# EasyEDA Pro project ProProject_Avaota Pi A_2024-03-25.epro, board 点位 (continued)
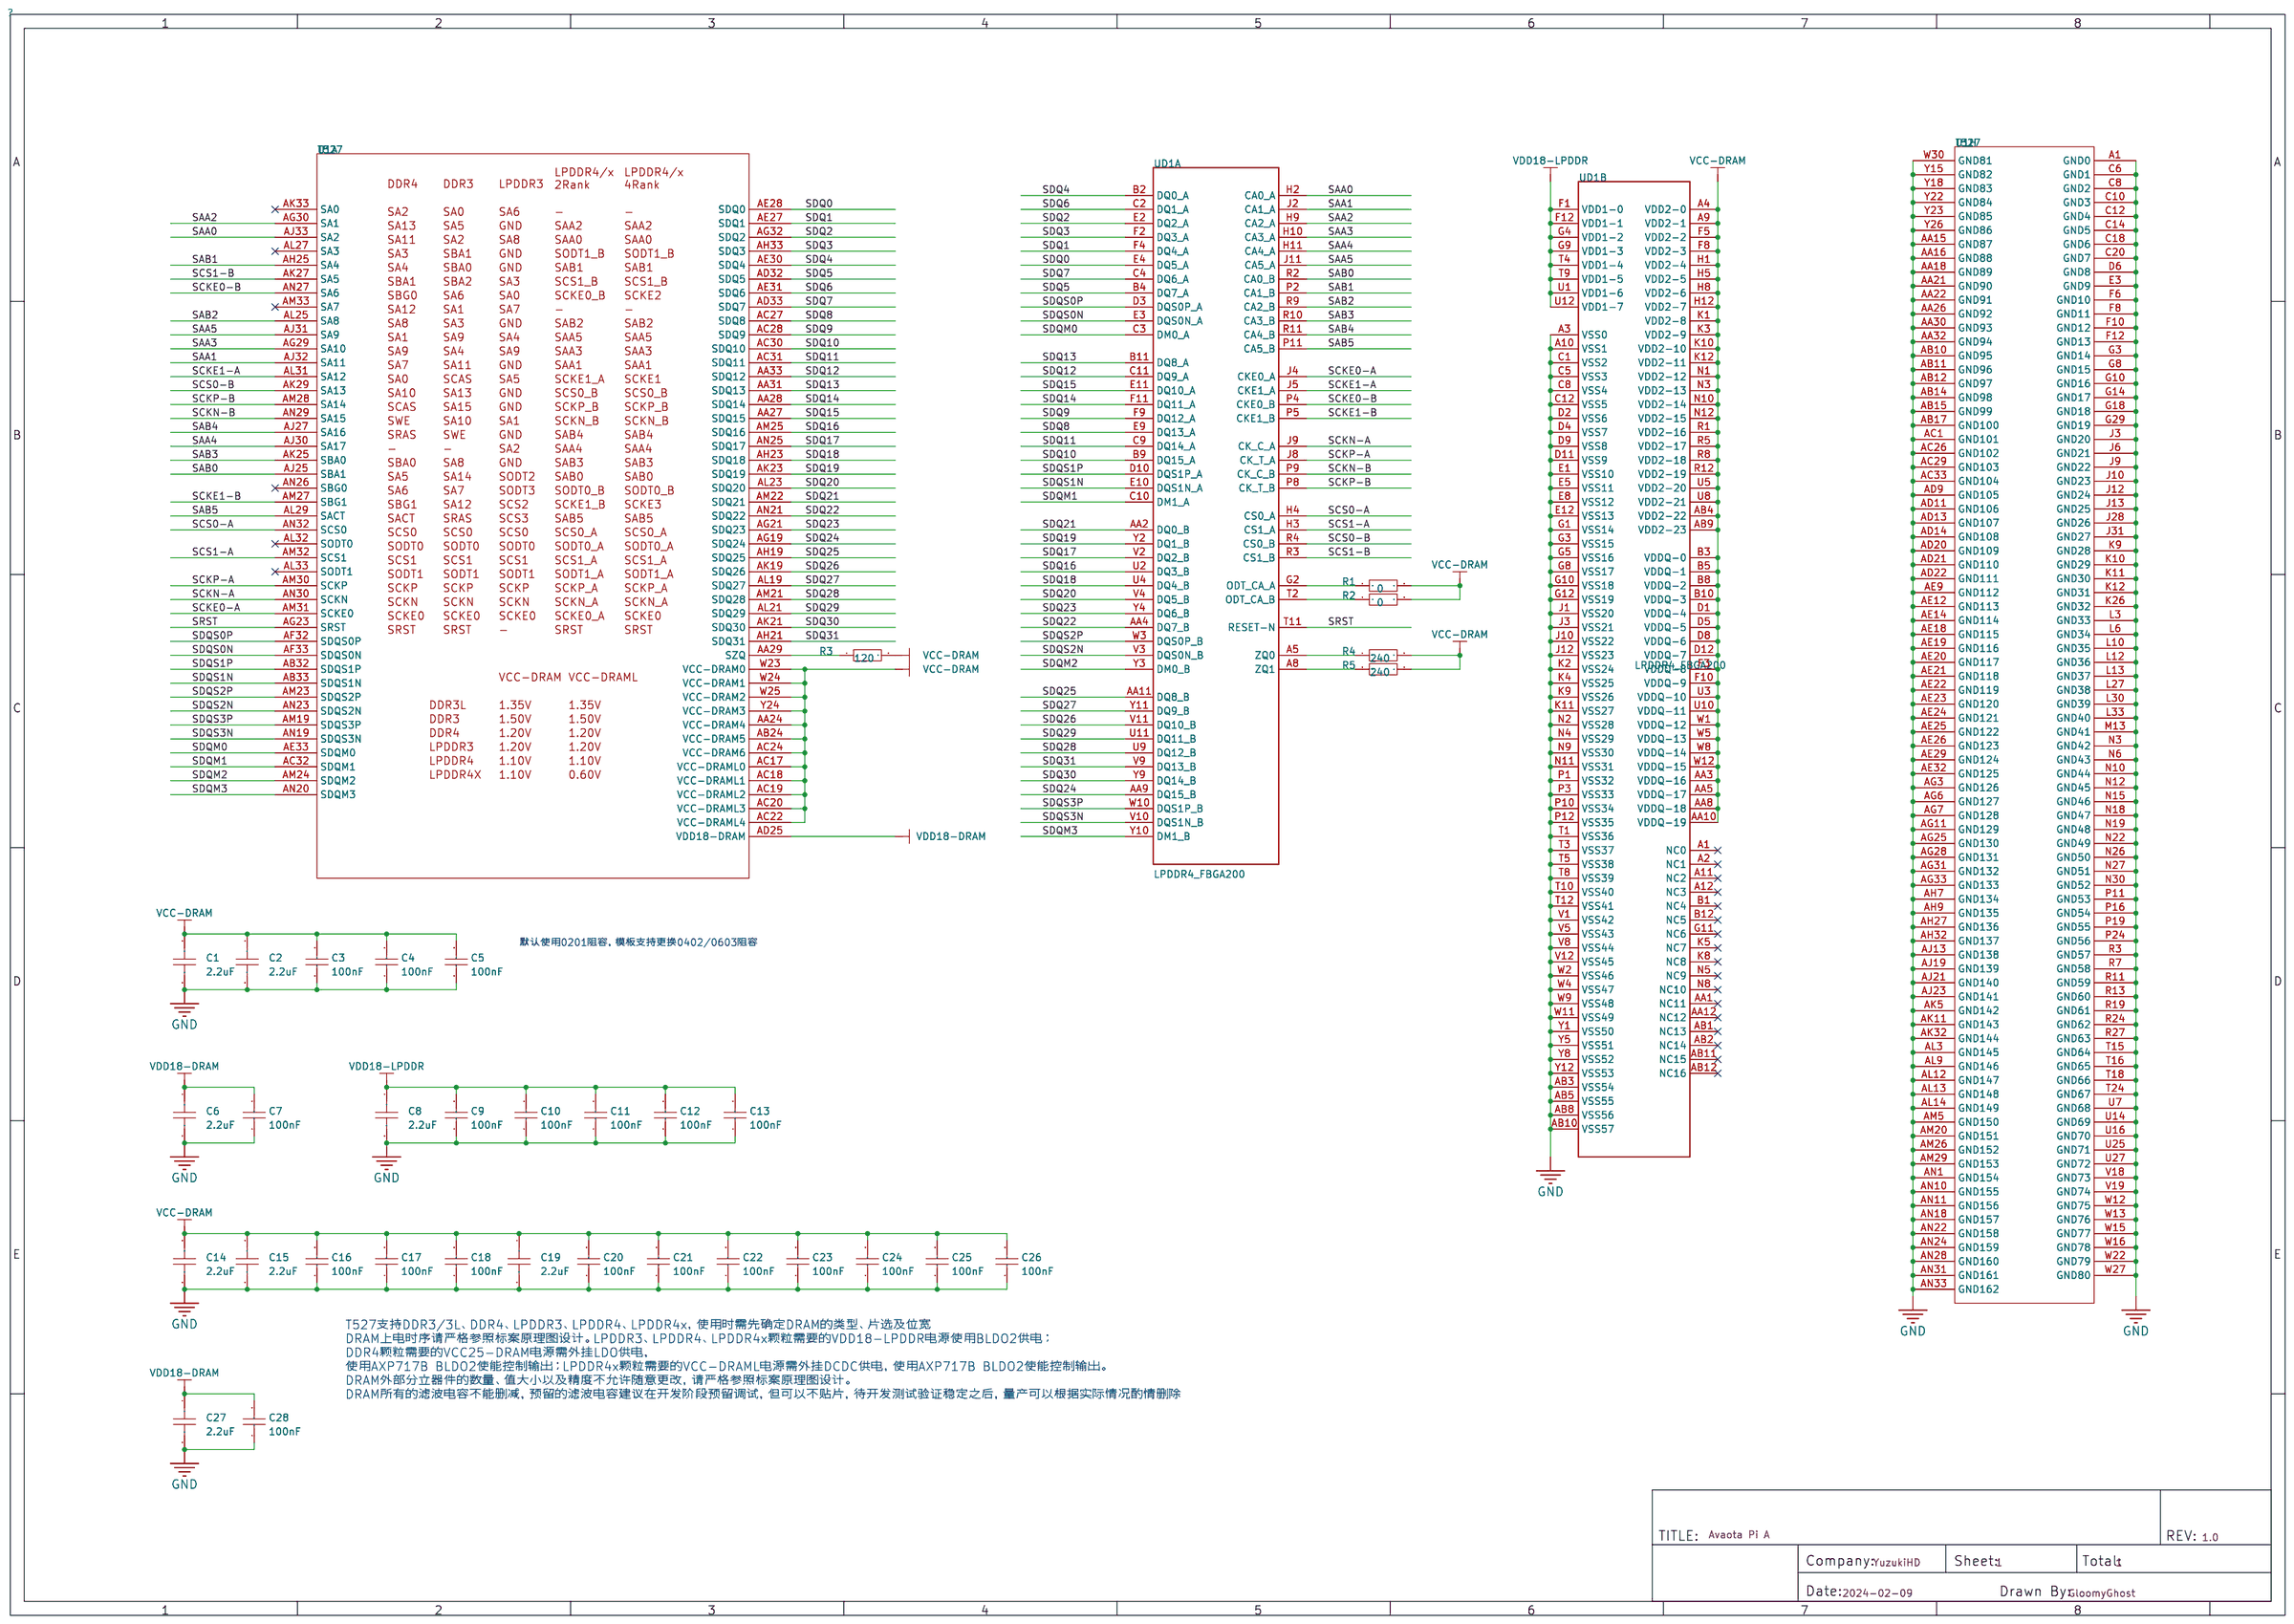
[diagram p0: schematic sheet]
## Routing (per net, layer and track width the routed paths; a pad name or vN(x,y) marks a point on that pad's centre or on a via; arc(x,y) is an arc through that point) (continued)
VDD-CPUBFB: length 71
  Top Layer w0.203: v3(17.37,44.68) 17.31,44.68 U5.1 ; v3(17.65,41.86) 17.66,41.87 U5.16
  内层2 w0.254: v1(62.44,45.65) 63.32,45.65 64.01,46.33 64.01,46.86 63.37,47.5 63.37,49.07 62.31,50.14 61.72,50.14 61.49,50.37 61.49,50.88 61.95,51.33 61.95,52.02 61.9,52.02 61.29,52.63 61.29,53.49 60.88,53.9 59.82,53.9 57.18,56.54 56.57,56.54 55.63,57.48 55.63,57.84 52.58,60.88 31.9,60.88 27.1,56.08 27.1,53.19 18.59,44.68 v3(17.37,44.68)
  Bottom Layer w0.254: v3(17.37,44.68) 17.81,44.68 18.26,44.22 18.26,43.49 17.65,42.88 v3(17.65,41.86)
VDD-CPULFB: length 62
  Top Layer w0.152: U4.12 10.87,48.88 v3(10.87,48.31)
  Inner5 w0.254: v3(10.87,48.31) 10.39,47.83 10.39,45.85 11.38,44.86 13.61,44.86 17.93,49.17 25.6,49.17 32.56,56.13 46.25,56.13 51.23,51.16 51.82,51.16 52.1,50.88 52.1,50.29 52.68,49.71 53.62,49.71 54.15,49.17 57.61,49.17 57.94,48.84 58.42,48.84 58.85,48.41 58.85,47.42 59.13,47.14 v1(59.44,47.14)
VDD-DNRFB: length 52.6
  Top Layer w0.203: v1(15.34,45.92) 15.47,45.92 15.65,45.75 15.65,45.01 15.85,44.8 U5.4
  VCC w0.254: v1(15.34,45.92) 15.8,46.38 22.4,46.38 31.88,55.85 45.85,55.85 52.48,49.23 58.02,49.23 v1(58.94,50.15)
VDD-SYSFB: length 65.7
  Top Layer w0.203: v3(8.05,54.15) 8.06,54.17 U4.34
  Top Layer w0.254: v1(62.94,48.16) 62.94,47.65
  内层4 w0.254: v1(62.94,48.16) 62.94,48.01 62.56,47.62 60.27,47.62 58.75,49.15 52.55,49.15 45.47,56.24 20.07,56.24 16.87,59.44 14.55,59.44 13.94,60.05 10.85,60.05 9.09,58.29 9.09,57.05 8.05,56.01 v3(8.05,54.15)
323-ALDO1: length 0.8
  Top Layer w0.203: U5.15 17.05,40.9 C69.1
323-DCDC1/2: length 10.9
  Top Layer w0.203: 61.95,46.66 61.95,46.15 U14.T21 ; 61.95,46.66 61.95,47.14 U14.T19 ; 61.95,46.66 v1(61.44,46.66) ; 61.44,46.66 U14.U19 U14.U18 ; v1(61.44,46.66) v1(60.93,46.66) 60.96,46.63 v1(60.96,46.15) ; v1(61.44,46.66) U14.U21
  Bottom Layer w0.254: v1(61.94,45.65) 61.95,45.64 C22.1 62.5,45.12 62.51,45.14 ; v1(61.94,45.65) v1(61.44,45.65) ; v1(61.94,45.65) 61.94,46.94 C24.1 C19.1 61.44,46.88 v1(61.44,46.66) ; v1(61.44,46.66) v1(60.93,46.66) 60.96,46.63 v1(60.96,46.15) 60.96,45.71 60.9,45.64 ; v1(61.44,46.66) v1(61.44,45.65) ; v1(61.44,45.65) C23.1
  vias: v3(21.97,45.01) v3(21.97,44.36) v3(21.97,43.69) v3(21.97,43.05) v3(21.97,42.48) v3(21.97,41.76) v3(22.05,41.05) v3(22.57,41.05)
323-DCDC3: length 5.1
  Top Layer w0.254: v1(59.94,49.64) v1(59.94,50.15) U14.Y12 ; U14.AA12 v1(59.44,50.15) v1(59.44,49.64)
  Bottom Layer w0.254: v1(59.44,50.15) v1(59.44,49.64) 59.44,49.51 C83.1 ; C84.1 C83.1 ; C83.1 59.77,49.46 v1(59.94,49.64) 60.12,49.46 C86.1 ; C85.1 59.94,49.53 v1(59.94,50.15)
  vias: v3(18.21,48.49) v3(18.21,47.89) v3(18.73,47.89) v3(18.72,47.34)
323-DLDO1: length 0.8
  Top Layer w0.203: C71.1 15.85,40.91 U5.12
323-RTCLDO: length 1.1
  Top Layer w0.203: U5.7 14.84,43.41 14.3,43.41 14.1,43.61 C73.1
ADCIN0: length 4.1
  Bottom Layer w0.152: C106.2 60.67,55.42 R26.2 60.83,55.33 60.83,52.54
  Bottom Layer w0.178: v3(60.44,52.15) 60.83,52.54
ADCIN1: length 4.7
  Bottom Layer w0.178: v3(60.44,51.65) 60.51,51.65 61.14,52.27 61.14,55.07 61.28,55.21 R27.2 61.28,55.94 C107.2
ALDO1: length 2.2
  Top Layer w0.203: U4.13 11.63,49.2 11.63,48.92 12.01,48.54 12.27,48.54 12.47,48.34 12.47,48.11 12.75,47.83 C51.1
ALDO2: length 2
  Top Layer w0.203: C52.1 12.84,48.41 12.09,49.17 12.09,49.43 11.89,49.63 U4.14
ALDO3: length 80.2
  Top Layer w0.152: R12.1 R11.1 v3(5.18,47.12)
  Top Layer w0.203: U4.16 11.94,50.43 12.69,49.68 12.69,49.53 v1(12.92,49.53)
  Top Layer w0.254: v1(56.44,52.15) U14.AE11
  Top Layer w0.457: v1(49.53,61.54) 49.53,61.57 v1(49.15,61.95) 49.05,62.05 v1(42.11,62.05) v1(41.5,62.05)
  VCC w0.152: v3(5.18,47.12) 5.53,47.47 5.99,47.47 6.58,48.06 6.58,49.15 6.43,49.3 6.43,49.71 6.81,50.09 6.81,54 7.39,54.58 11.13,54.58 11.96,53.75 11.96,52.86 12.47,52.35 12.47,49.97 v1(12.92,49.53)
  Inner5 w0.457: v1(12.92,49.53) 12.57,49.53 12.14,49.96 12.14,51.21 12.73,51.79 13.37,51.79 14.79,53.21 18.62,53.21 20.6,55.19 22.92,55.19 29.78,62.05 v1(41.5,62.05)
  Bottom Layer w0.254: v1(49.53,61.54) 49.5,61.52 49.5,60.17 50.6,59.08 50.6,57.66 52.15,56.11 52.15,55.47 53.62,54 53.92,54 54.15,54.23 54.79,54.23 54.91,54.1 55.19,54.1 55.45,53.85 55.45,53.49 56.44,52.5 v1(56.44,52.15)
ALDO4: length 103.7
  Top Layer w0.102: v3(59.79,59.82) R31.2 60.35,59.37 ; R20.2 60.91,59.37 60.35,59.37 ; 60.35,59.37 R19.2 ; v3(58.67,59.84) R30.2 ; v3(56.97,59.79) R32.2
  Top Layer w0.203: U14.AD15 U14.AG15 ; v1(12.92,50.09) 12.85,50.09 12.11,50.83 U4.17 ; v3(60.44,53.15) 59.95,52.65 59.26,52.65 58.94,52.34 U14.AB9
  Top Layer w0.254: U14.AG15 56.44,49.14 v1(56.44,48.62)
  内层2 w0.254: v3(56.97,59.79) 56.97,59.56 57.25,59.28 58.22,59.28 58.67,59.74 v3(58.67,59.84)
  VCC w0.381: 58.93,49.35 57.74,48.16 57.2,48.16 56.74,48.62 v1(56.44,48.62) ; 58.93,49.35 59.21,49.07 60.35,49.07 60.93,49.66 v1(60.93,51.43) 60.93,52.65 v3(60.44,53.15) 59.68,53.15 58.85,53.98 58.85,57 58.39,57.46 58.39,58.47 58.67,58.75 v3(58.67,59.84) 58.67,60.05 58.98,60.35 59.46,60.35 59.79,60.02 v3(59.79,59.82) ; 58.93,49.35 58.93,45.36 58.72,45.16 58.19,45.16 57.94,44.91 v3(57.94,44.15)
  Inner5 w0.457: 12.92,50.09 12.92,50.09 13.39,50.09 13.87,50.57 13.87,51.26 15.09,52.48 18.77,52.48 ; 18.85,52.53 20.8,54.48 23.3,54.48 30.11,61.29 45.82,61.29 48.77,58.34 54.53,58.34 56.87,56.01 58.7,56.01 60.44,54.26 v3(60.44,53.15)
  Bottom Layer w0.127: R24.2 60.19,51.26 60.76,51.26 v1(60.93,51.43)
  Bottom Layer w0.152: v3(60.44,53.15) 60.44,53.2 59.72,53.92
  Bottom Layer w0.203: v3(60.44,53.15) 60.25,53.34 59.72,53.34
  Bottom Layer w0.254: C90.2 C93.2 56.24,48.91 56.44,48.71 v1(56.44,48.62) ; C133.2 57.94,43.67 57.94,44.02 ; 57.94,44.02 57.63,43.71 57.21,43.71 56.7,44.22 52.72,44.22 52.58,44.37 ; 57.94,44.02 v3(57.94,44.15) ; 52.58,44.37 51.62,44.37 51.61,44.36 ; 52.58,44.37 52.55,44.34
ALDO-OUT: length 0.4
  Bottom Layer w0.178: v3(57.44,53.15) 57.43,53.14 57.43,53.14 C103.2
AP-NMI: length 84.7
  Top Layer w0.076: 53.04,51.4 53.7,51.4
  Top Layer w0.102: v1(7.57,54.08) 7.09,54.08 6.83,54.33 6.83,54.73 U4.37 ; U14.AM10 53.94,51.65 53.7,51.4 ; v3(52.81,51.63) 53.04,51.4
  Top Layer w0.127: v3(13.41,41.76) 15.3,41.76 U5.11
  Top Layer w0.152: R10.2 7.79,48.01 v1(7.39,48.01)
  VCC w0.102: v1(7.44,49.58) 7.07,49.96 7.07,53.57 v1(7.57,54.08)
  VCC w0.152: v1(7.44,49.58) 7.39,49.53 v1(7.39,48.01)
  Bottom Layer w0.102: v3(52.81,51.63) 52.79,51.61 51.99,51.61 47.65,55.96 43.84,55.96 42.27,57.53 36.37,57.53 35.69,56.85 13.59,56.85 11.91,55.17 11.91,50.62 11.71,50.42 9.6,50.42 9.09,49.91 7.77,49.91 v1(7.44,49.58) 7.09,49.23 6.53,49.23 5.77,49.99 4.98,49.99 4.52,49.53 4.52,48.77 5.26,48.03 5.26,47.85 4.8,47.4 4.8,46.91 5.28,46.43 5.28,45.8 6.66,44.42 12.27,44.42 13.28,43.41 13.28,41.88 v3(13.41,41.76)
  Bottom Layer w0.254: C94.2 53.28,51.63 v3(52.81,51.63)
AP-RESET: length 84.1
  Top Layer w0.127: U5.13 16.25,41.03 v3(16.26,41.02)
  Top Layer w0.152: C95.2 6.77,47.97 R9.2 6.31,48.01 6.31,48.45 6.46,48.6 U4.1 6.46,49.49 6.58,49.61 v1(6.86,49.61)
  Top Layer w0.254: v3(55.45,51.64) 55.45,51.15 U14.AJ11
  VCC w0.127: v1(14.6,44.3) 14.5,44.2 8.84,44.2 ; v1(8.84,43.13) 8.84,44.2 ; 8.84,44.2 6.83,46.2 6.83,49.58 v1(6.86,49.61)
  Bottom Layer w0.102: v1(6.86,49.61) 7.44,50.19 9.04,50.19 9.47,50.62 11.48,50.62 11.68,50.83 11.68,55.4 13.41,57.12 35.51,57.12 36.25,57.86 42.37,57.86 43.99,56.24 47.78,56.24 52.15,51.87 52.55,51.87 52.65,51.97 52.7,51.97 52.88,52.15 54.66,52.15 55.14,51.66 55.4,51.66
  Bottom Layer w0.127: R21.2 8.82,43.15 v1(8.84,43.13) ; v1(14.6,44.3) 14.6,42.67 v3(16.26,41.02)
AP-WAKE-BT: length 52.7
  Top Layer w0.102: v3(61.95,54.65) U14.U4
  Top Layer w0.203: 15.72,60.6 15.61,60.5 R69.2
  Top Layer w0.254: v3(17.02,60.53) U9.6
  Inner5 w0.102: v3(17.02,60.53) 17.6,59.94 19.3,59.94 22.07,62.71 45.14,62.71 48.97,58.88 55.07,58.88 56.34,57.61 57.84,57.61 60.8,54.65 v3(61.95,54.65)
AXP717-CC1: length 3.9
  Top Layer w0.102: D24.2 86.66,66.43 86.66,65.35 86.98,65.04 R130.2
  Top Layer w0.127: 87.07,66.86 87.07,67.44 86.92,67.59 86.92,68.53 USB3.A5
AXP717-CC2: length 2.8
  Top Layer w0.102: R129.2 83.11,66.92 D31.2
  Top Layer w0.127: USB3.B5 83.9,67.6 D31.2 83.13,66.84
BLDO1: length 102
  Top Layer w0.152: v1(16.1,53.95) 16.07,53.91 16.07,52.07 ; U14.N9 v3(63.44,52.58) ; U14.T9 62.08,52.15 62.46,52.53 v3(62.46,52.68)
  Top Layer w0.203: U4.18 12.2,51.23 12.78,50.65 v1(12.92,50.65)
  Top Layer w0.254: C179.2 C180.2 14.12,61.71 v1(14.12,61.19) 14.12,60.53 ; 14.12,60.53 R69.1 ; 14.12,60.53 14.12,59.91 R70.1
  Top Layer w0.508: v1(24.71,57.99) 26.04,56.66 U9.22
  VCC w0.254: v1(16.1,53.95) 16.1,54.58 16,54.69
  VCC w0.381: v1(56.92,53.62) 56.44,53.14 54.2,53.14 53.75,53.59
  VCC w0.508: 53.75,53.7 47.29,60.15 30.4,60.15 v1(28.68,58.42) 24.94,54.69 14.49,54.69 13.99,54.18 13.99,51.25 13.39,50.65 v1(12.92,50.65)
  Inner5 w0.254: v1(63.42,44.65) 63.55,44.53 64.08,44.53 64.44,44.88 64.44,47.04 64.9,47.5 64.9,49.81 64.57,50.14 64.21,50.14 62.99,51.36 62.66,51.36 61.87,52.15 ; 62.07,52.15 61.87,52.15 ; 62.07,52.15 63.12,52.15 63.44,52.47 v3(63.44,52.58) ; 62.07,52.15 62.46,52.54 v3(62.46,52.68) ; 61.87,52.15 61.42,52.15 60.91,52.65 58.22,52.65 57.91,52.96 57.91,53.31 57.51,53.72 57.02,53.72 v1(56.92,53.62)
  Bottom Layer w0.254: C165.2 63.45,52.58 v3(63.44,52.58) ; C172.2 56.44,53.95 56.77,53.62 v1(56.92,53.62) ; v1(63.42,44.65) 63.32,44.55 C166.2 C171.2
  Bottom Layer w0.508: v1(28.68,58.42) 25.15,58.42 v1(24.71,57.99) 17.81,57.99 14.6,61.19 v1(14.12,61.19)
BLDO2: length 52.1
  Top Layer w0.102: 35.81,50.05 v2(35.46,49.7)
  Top Layer w0.127: v3(16.64,40.64) 16.65,40.66 U5.14
  Top Layer w0.203: U4.19 12.38,51.63 12.8,51.21 v1(12.92,51.21)
  Top Layer w0.254: 35.81,44.2 36.04,43.97 36.22,43.97 36.23,43.96 v2(36.23,43.96) ; 33.41,50.7 v2(33.1,50.39) 33.07,50.39 32.37,51.09 32.23,51.09 32.23,51.71 ; v2(39.38,43.77) 39.4,43.77 39.81,44.18 39.81,44.2 ; 42.21,43.55 42.15,43.55 v2(41.81,43.21) ; 32.23,43.71 32.7,43.71 v2(32.87,43.55) 33.41,43.55 ; v2(39.39,50.32) 39.54,50.32 39.81,50.05
  Top Layer w0.305: v2(41.83,50.36) 41.84,50.37 41.87,50.37 42.21,50.7
  内层4 w0.508: v2(33.1,50.39) 32.48,50.39 31.57,49.48 17.83,49.48 15.75,51.56 v1(15.06,51.56) 13.27,51.56 v1(12.92,51.21)
  Bottom Layer w0.152: v3(16.64,40.64) 16.64,41.22 15.06,42.8 15.06,44.78 14.48,45.36 14.48,50.98 v1(15.06,51.56)
  Bottom Layer w0.203: v2(39.38,43.77) 39.8,44.19 39.8,44.93 41.12,44.93 41.81,44.25 41.81,43.87
  Bottom Layer w0.254: v2(35.46,49.7) 35.45,49.7 35.02,49.28 34.39,49.28 34.16,49.51 34.16,49.96 33.78,50.34 33.14,50.34 v2(33.1,50.39) ; 38.78,43.26 39.3,43.77 v2(39.38,43.77) ; 35.99,44.4 35.99,44.2 v2(36.23,43.96) ; v2(32.87,43.55) 32.83,43.55 ; 41.81,43.87 v2(41.81,43.21)
BLDO3: length 84.1
  Top Layer w0.152: U14.AJ5 55.64,53.95 v3(55.93,53.95)
  Top Layer w0.203: U4.21 11.6,52.43 12.81,52.43 v1(12.92,52.32)
  Top Layer w0.254: U14.L22 63.96,45.16 v1(63.96,45.09) ; U14.J15 65.46,49.16 64.96,49.66 64.45,49.66 ; 64.45,49.66 U14.K13 ; 64.45,49.66 v1(64.44,49.66) ; v1(63.53,46.63) 63.94,46.22 U14.M21 ; v1(63.96,51.13) 63.96,51.63 U14.M10
  内层2 w0.254: v1(70.36,52.73) 70,52.73 68.94,51.66 65.63,51.66 65.1,51.13 v1(63.96,51.13)
  VCC w0.381: v1(12.92,52.32) 13.41,52.82 13.41,54.46 14.25,55.3 24.56,55.3 30.1,60.83 47.4,60.83 54.1,54.13 55.75,54.13 v3(55.93,53.95)
  Bottom Layer w0.127: C187.2 64.36,47.55
  Bottom Layer w0.254: C202.2 55.62,54.26 v3(55.93,53.95) ; R127.1 R128.1 70.28,52.81 v1(70.36,52.73) ; v1(63.96,45.09) 64.01,45.03 C201.2
  Bottom Layer w0.381: 63.96,50.14 C208.2 61.11,50.14 60.6,50.65 59,50.65 57.99,51.66 57.18,51.66 56.95,51.89 56.95,52.68 55.93,53.7 v3(55.93,53.95)
  Bottom Layer w0.457: 64.36,47.55 65,48.18 65,49.38 64.72,49.66 v1(64.44,49.66) 63.96,50.14 v1(63.96,51.13) ; 64.52,47.52 63.63,46.63 v1(63.53,46.63) 63.83,46.33 C186.2 C185.2 63.83,45.21 v1(63.96,45.09)
BLDO4: length 1.3
  Top Layer w0.203: C65.1 12.89,52.83 U4.22
BOOT-SEL-ADC: length 4.3
  Top Layer w0.076: 59.83,57.33 60.07,56.44 60.42,56.18
  Top Layer w0.102: 59.83,57.33 59.83,58.3 59.59,58.55 58.98,58.55 58.67,58.85 ; R33.2 58.64,58.89 58.67,58.85 ; 58.67,58.85 R30.1
BT-RESETN: length 45.6
  Top Layer w0.076: 61.44,55.14 61.19,55.39 61.19,56.38 61.18,56.38 60.96,56.79 60.91,57.23 60.93,57.78
  Top Layer w0.102: 60.93,57.76 60.93,58.11 61.49,58.67 61.49,59.72 60.99,60.22 56.64,60.22 54.86,58.45 36.14,58.45 v3(35.94,58.24) ; 26.06,66.45 v1(26.06,65.19)
  Bottom Layer w0.102: v3(35.94,58.24) 35.53,58.65 35.41,58.65 28.86,65.19 v1(26.06,65.19)
BT-WAKE-AP: length 54.8
  Top Layer w0.102: U14.U5 v3(61.95,54.15)
  Top Layer w0.203: R70.2 15.56,59.87 15.72,59.7
  Top Layer w0.254: v3(17.5,60.71) 17.5,60.2 17.22,59.92 16.54,59.92 16.24,59.63 15.7,59.63
  Inner5 w0.102: v3(17.5,60.71) 17.5,60.5 17.81,60.2 19.15,60.2 22.02,63.07 45.19,63.07 49.07,59.18 55.14,59.18 56.44,57.89 57.96,57.89 60.86,54.99 62.1,54.99 62.31,54.79 62.31,54.5 v3(61.95,54.15)
CAN-RX0: length 116.6
  Top Layer w0.152: v3(55.42,48.59) 55.42,48.16 U14.AJ17
  内层2 w0.102: v3(55.42,48.59) 55.42,48.83 55.18,49.07 54.14,49.07 51.84,51.37 51.84,54.43 49.86,56.41 46.96,56.41 46,57.38 45.77,57.38 v1(45.39,57.76)
  内层4 w0.102: v1(44.17,64.85) 45.42,66.09 52.43,66.09 57.56,60.96 60.91,60.96 62.28,59.59 86.11,59.59 88.72,56.97 88.72,53.72 87.25,52.25 87.25,33.07 94.49,25.83 95.73,25.83 98.58,22.99 v1(98.58,21.51)
  Bottom Layer w0.102: v1(44.17,64.85) 44.17,64.14 44.4,63.91 44.4,60.12 45.57,58.95 45.57,57.94 v1(45.39,57.76) ; U11.4 98.83,21.77 v1(98.58,21.51)
CAN-TX0: length 108.9
  Top Layer w0.152: U14.AH17 55.93,48.16 v3(55.93,48.59)
  内层2 w0.102: v1(45.97,57.79) 45.98,57.79 47.1,56.67 50.04,56.67 52.1,54.61 52.1,51.46 54.25,49.31 55.34,49.31 55.93,48.72 v3(55.93,48.59)
  内层4 w0.102: v1(94.84,25.4) 94.46,25.4 86.89,32.97 86.89,52.35 88.42,53.87 88.42,56.87 85.95,59.33 62.13,59.33 60.78,60.68 57.35,60.68 52.25,65.79 45.67,65.79 v1(44.7,64.82)
  Bottom Layer w0.102: v1(94.84,25.4) 95.02,25.22 U11.1 ; v1(45.97,57.79) 45.97,59 44.7,60.27 v1(44.7,64.82)
CLDO1: length 79
  Top Layer w0.127: v3(35.59,34.52) 35.8,34.52 U8.P3 U8.N4 ; U8.N4 U8.P5 ; U8.N4 U8.M4
  Top Layer w0.203: C60.2 12.73,53.39 12.56,53.23 U4.23
  Top Layer w0.254: v3(41.22,33.3) 41.58,33.3 U8.C6
  Bottom Layer w0.508: v3(12.88,53.39) 13.79,52.48 13.79,42.32 20.62,35.48 35.03,35.48 35.59,34.93 v3(35.59,34.52) 35.59,32.39 36.3,31.67 41.18,31.67 ; v3(41.22,33.3) 41.22,31.72 41.18,31.67 ; 41.18,31.67 42.22,31.67 44.98,34.44 57.07,34.44 60.55,37.92 60.55,39.95 61.44,40.84 v3(61.44,43.64)
CLDO2: length 134
  Top Layer w0.203: v1(12.92,53.95) 12.63,53.95 12.31,53.63 U4.24
  Top Layer w0.254: v1(62.03,41.91) 62.03,43.23 U14.R26
  VCC w0.254: v1(12.92,53.95) 12.92,54.29 11.57,55.64 7.27,55.64 5.92,54.28 5.92,52.96 3.68,50.72 3.68,23.55 7.14,20.09 21.16,20.09 21.62,20.55 25.83,20.55 31.8,26.52 37.54,26.52 38.86,27.84 38.86,32.23 38.15,32.94 38.15,33.43 38.53,33.81 39.98,33.81 40.36,33.43 40.36,29.16 40.87,28.65 60.05,28.65 65.05,33.66 65.05,38.89 v1(62.03,41.91)
  Bottom Layer w0.254: v1(62.03,41.91) 62.48,42.37 62.48,43.03 C91.2
CLDO4: length 2.6
  Top Layer w0.203: C66.2 12.79,55.45 12.6,55.45 12.34,55.19 10.92,55.19 10.86,55.14 U4.27
CPUSLDO: length 54.8
  Top Layer w0.203: v1(15.14,53.92) 15.14,54.66 14.22,55.58 C35.2 14.05,55.6 14.05,55.72 13.76,56.01 12.67,56.01 12.17,55.5 10.79,55.5 10.46,55.17 U4.28 ; U14.AC15 v1(58.44,50.37)
  Bottom Layer w0.203: v1(58.44,50.37) 58.26,50.19 57.81,50.19 57.18,50.83 52.32,50.83 51.79,50.29 51.44,50.29 51.1,50.62 51.1,51.21 47.17,55.14 16.28,55.14 15.14,54 v1(15.14,53.92)
CPUX-RX: length 120.9
  Top Layer w0.127: USB3.B8 87.4,67.69 v1(87.66,67.43) 87.99,67.11 D30.2 ; v3(62.95,42.15) U14.R29
  内层2 w0.102: 87.66,67.44 86.61,68.48 82.91,68.48 82.17,67.74 64.21,67.74 63.55,68.4 20.22,68.4 19.33,69.29 19.33,71.96 H1.10
  VCC w0.102: v1(87.66,67.43) 87.66,67.11 87.25,66.7 84.23,66.7 83.59,67.34 82.45,67.34 80.42,65.3 80.42,53.29 74.93,47.8 v1(74.93,45.52)
  内层4 w0.102: v1(74.93,45.52) 74.73,45.52 73.89,44.68 71.07,44.68 69.9,43.51 66.6,43.51 66.09,43 63.81,43 v3(62.95,42.15)
CPUX-TX: length 115.9
  Top Layer w0.127: USB3.A8 84.4,67.19 D27.2 ; U14.R28 v3(62.95,42.64)
  内层2 w0.102: H1.8 16.87,71.88 16.87,69.85 17.35,69.37 18.82,69.37 20.04,68.15 63.37,68.15 64.06,67.46 82.32,67.46 83.08,68.22 84,68.22 84.4,67.82 v1(84.4,67.34)
  VCC w0.102: v1(74.42,45.8) 74.63,46 74.63,48.03 80.09,53.49 80.09,65.46 82.25,67.62 83.74,67.62 84.01,67.34 v1(84.4,67.34)
  内层4 w0.102: v3(62.95,42.64) 63.56,43.26 65.94,43.26 66.47,43.79 69.77,43.79 70.92,44.93 73.71,44.93 74.42,45.64 v1(74.42,45.8)
CPVDD: length 1.2
  Top Layer w0.152: U14.AJ3 v3(55.92,55.15)
  Bottom Layer w0.152: C105.2 55.92,55.85 v3(55.92,55.15)
CPVEE: length 3.3
  Top Layer w0.152: U14.AK2 54.94,55.64 v3(54.94,55.19) ; v3(55.92,54.65) U14.AJ4
  Bottom Layer w0.152: v3(55.92,54.65) 55.79,54.65 55.45,54.99 55.45,55.79 C115.2 55.4,55.65 v3(54.94,55.19)
CTP-INT: length 72.6
  Top Layer w0.076: 62.79,40.39 62.78,40.39 ; 62.79,40.39 62.84,40.34 ; 62.79,40.39 62.84,40.35 62.84,40.34 ; 62.79,40.39 62.69,40.48 62.69,40.9 62.44,41.15 ; 62.84,40.34 62.85,40.18 62.85,40.11 62.85,40.09 62.85,39.94 62.75,39.83 62.75,38.31 62.78,38.17 62.92,37.94 63.11,37.67
  Top Layer w0.102: v3(63.35,36.42) 63.22,36.55 63.22,37.57 63.12,37.67
  Inner5 w0.127: v3(25.1,23.72) 25.43,24.05 25.43,29.29 28.6,32.46 42.57,32.46 45.21,35.1 60.93,35.1 62.26,36.42 v3(63.35,36.42)
  Bottom Layer w0.127: v3(25.1,23.72) 19.94,23.72 18.21,22 7.67,22 6.45,20.78 FPC1.35
CTP-RST: length 76
  Top Layer w0.127: v3(62.95,41.65) U14.R30
  内层2 w0.127: v3(24.69,23.27) 25.37,23.27 26.31,24.21 26.31,26.24 26.77,26.7 26.77,32.31 30.61,36.14 36.68,36.14 36.68,36.14 37.62,35.2 38.61,35.2 39.17,34.65 39.17,34.09 39.4,33.86 39.93,33.86 40.59,34.52 41.94,34.52 42.88,33.58 53.06,33.58 55.63,36.14 60.43,36.14 62.51,38.23 62.51,39.17 62.95,39.61 v3(62.95,41.65)
  Bottom Layer w0.127: FPC1.36 6.56,20.28 7.87,21.59 18.49,21.59 20.17,23.27 v3(24.69,23.27)
CTP-SCK: length 72.5
  Top Layer w0.076: 62.44,40.5 62.54,40.38 62.68,40.26 62.69,40.17 62.69,40 62.57,39.89 62.57,38.33 62.63,38.04 62.82,37.77 62.91,37.53 ; 62.44,40.5 62.44,40.65
  Top Layer w0.102: v3(63.09,35.97) 62.97,36.09 62.97,37.48 62.92,37.53
  Inner5 w0.127: v3(24.26,22.83) 24.36,22.73 24.84,22.73 25.78,23.67 25.78,29.08 28.73,32.03 42.8,32.03 45.44,34.67 61.06,34.67 62.36,35.97 v3(63.09,35.97)
  Bottom Layer w0.127: v3(24.26,22.83) 20.42,22.83 18.8,21.21 8.08,21.21 6.65,19.78 FPC1.37
CTP-SDA: length 71.9
  Top Layer w0.076: 62.49,37.77 62.33,38.32 62.31,38.78 62.32,39.2 62.31,39.51 62.38,39.71 62.37,39.87 62.42,40.12
  Top Layer w0.102: v3(62.74,35.56) 62.67,35.63 62.67,37.56 62.6,37.63 62.48,37.77
  Inner5 w0.127: v3(23.83,22.38) 23.93,22.28 24.97,22.28 26.14,23.44 26.14,28.88 28.88,31.62 42.98,31.62 45.59,34.24 61.42,34.24 v3(62.74,35.56)
  Bottom Layer w0.127: v3(23.83,22.38) 20.65,22.38 19.08,20.8 8.2,20.8 6.68,19.28 FPC1.38
DCDC1: length 4.6
  Bottom Layer w0.254: 60.16,46.86 C41.1 60.16,46.43 ; 60.16,46.86 v1(60.44,47.15) 60.44,47.65 ; 60.16,46.86 60.16,46.93 v1(59.94,47.15) 59.94,47.68 C36.1 C37.1 59.4,47.74 C40.1 ; 60.16,46.43 v1(60.44,46.15) ; 60.16,46.43 60.16,46.36 v1(59.94,46.15) ; C38.1 60.44,47.66 60.44,47.65 ; 60.44,47.65 60.82,47.65 C39.1
  vias: v3(11.89,47.68) v3(11.89,46.96) v3(11.89,46.34) v3(12.4,47.26) v3(12.4,46.66) v3(12.4,46.13)
DCDC2: length 24.5
  Top Layer w0.254: U14.P21 U14.P22 ; U14.P21 62.97,46.17 v1(62.97,46.63) ; U14.P21 U14.N21 U14.M22 U14.L21 ; U14.P21 62.49,46.15 v1(62.46,46.18) v1(62.46,46.63) ; 62.43,48.15 v1(62.43,48.62) 62.43,49.14 U14.R15 62.44,49.32 62.15,49.61 v3(61.95,49.61) 61.95,50.14 U14.T13 U14.U13 U14.U12 61.47,50.67 v3(61.95,50.67) ; 62.43,48.15 62.43,48.16 v1(61.95,48.16) ; 62.43,48.15 U14.R17 U14.R18 ; v3(62.94,50.65) v3(62.46,50.65) 62.43,50.67 v3(61.95,50.67) ; v3(62.94,50.65) U14.N13 ; v3(62.94,50.65) 62.94,50.15 ; v1(63.96,48.13) 63.96,48.13 U14.L18 ; C218.2 8.41,59.08 v3(8.31,58.98) ; U14.T11 61.94,50.68 v3(61.95,50.67) ; C210.2 7.87,59.08 v3(7.77,58.98) ; U14.J16 v1(65.86,48.65)
  Bottom Layer w0.152: 66.43,51.61 66.43,52.03 66.32,52.15 ; C213.2 66.32,52.15 ; 66.32,52.15 C214.2
  Bottom Layer w0.254: 62.43,46.98 62.46,46.95 v1(62.46,46.63) v1(62.46,46.18) 62.95,46.18 C48.1 v1(62.97,46.63) C49.1 ; 62.94,51.13 C76.1 ; 62.94,51.13 63.41,51.13 C75.1 ; 62.94,51.13 v3(62.94,50.65) ; v3(61.95,50.67) 61.95,51.12 C77.1 ; C78.1 62.46,51.13 v3(62.46,50.65) ; 65.77,51.6 66.42,51.6 66.43,51.61 ; 65.77,51.6 C216.2 C215.2 C68.1 C67.1 C57.1 65.86,48.96 v1(65.86,48.65) 65.86,48.58 C58.1 ; 65.77,51.6 C211.2 C213.2 ; v1(62.43,48.62) 62.43,49.06 C47.1 62.42,49.29 62.1,49.61 v3(61.95,49.61)
  vias: v3(6.22,58.29) v3(6.76,58.29) v3(7.77,58.5) v3(8.33,58.5)
DCDC3: length 138.7
  Top Layer w0.115: 44.62,49.88 44.61,49.9 44.61,50.01
  Top Layer w0.203: 43.61,43.51 43.61,44.15 42.98,44.78 42.27,44.78 42.21,44.85 ; v3(10.06,54.18) 10.06,54.76 U4.29
  Top Layer w0.254: 35.81,53.95 35.81,54.4 v2(35.85,54.44) ; 42.64,46.08 42.57,46.15 42.21,46.15 ; v2(43.2,52.4) 43.2,52.31 42.9,52 42.21,52 ; 35.01,46.15 35.01,46.16 v2(35.48,46.63) ; 40.61,50.7 40.91,50.39 v2(40.99,50.39) ; v2(42.57,48.18) 42.48,48.1 42.21,48.1 ; 33.41,44.85 33.11,45.14 v2(33.01,45.14) ; 36.61,40.95 37.08,40.95 v2(37.16,40.87) ; 36.61,49.4 36.61,49.41 37.05,49.86 v2(37.05,49.87) 37.05,50.25 36.61,50.7 ; v2(35.41,53.7) 35.4,53.7 35.01,53.3 ; 40.61,46.15 40.84,46.15 v2(40.99,46) ; v2(41.48,54.53) 41.02,54.08 41.02,53.85 40.61,53.43 40.61,53.3 ; 36.61,44.85 36.92,44.85 v2(37.07,44.7) ; 33.01,45.86 32.66,45.52 32.23,45.52 32.23,44.91 ; 33.01,45.86 v2(33.07,45.92) 33.18,45.92 33.41,46.15 ; 33.01,45.86 v2(33.01,45.14) ; 36.61,43.55 36.97,43.55 v2(37.16,43.74) ; 36.61,53.3 37.02,53.3 v2(37.06,53.26) 37.56,53.26 v2(37.84,52.98) 37.84,53.42 38.12,53.7 38.67,53.7 39.01,53.36 39.01,53.3 ; 32.23,41.22 32.23,41.88 32.33,41.99 v2(32.97,41.99) 33.23,42.25 33.41,42.25 ; 42.21,49.4 43.61,49.4 v2(43.66,49.45) 43.74,49.53 44.4,49.53 44.68,49.81 44.68,50 44.66,50.01 ; v2(34.63,41.26) 34.63,41.26 34.94,40.95 35.01,40.95 ; 39.81,40.3 39.83,40.27 39.83,39.97 39.85,39.95 39.85,39.86 v2(39.87,39.85) ; v2(38.53,51.46) 39.01,51.94 39.01,52 ; v2(39.37,40.54) 39.01,40.9 39.01,40.95 ; 39.01,43.55 38.82,43.74 v2(38.5,43.74) ; 39.01,44.85 39.33,44.53 39.37,44.53 39.37,44.52 v2(39.37,44.52) ; 43.61,43.51 43.96,43.51 v2(44.19,43.74) ; 36.61,52 36.98,52.37 v2(37.11,52.37) ; v2(38.12,49.91) 38.12,49.94 38.5,50.32 38.62,50.32 39.01,50.7 ; 32.23,49.36 32.23,48.95 v2(32.26,48.92) ; v2(37.18,42.16) 37.1,42.25 36.61,42.25 ; 39.81,53.95 39.25,54.51 38.5,54.51 v2(38.43,54.58) ; v2(34.67,43.87) 34.99,43.55 35.01,43.55 ; 32.23,39.52 32.54,39.22 35.12,39.22 v2(35.68,39.78) 35.81,39.9 35.81,40.3 ; 35.01,50.7 34.81,50.7 v2(34.57,50.94) ; 32.23,47.27 32.23,47.85 33.02,47.85 v2(33.14,47.73) 33.41,47.99 33.41,48.1 ; 32.23,54.1 32.23,53.47 32.52,53.47 32.87,53.12 32.87,52.4 v2(32.97,52.3) 33.27,52 33.41,52 ; 39.01,42.25 39.34,41.91 v2(39.39,41.91) ; v2(33.01,45.14) 33,45.12 ; v2(42.59,42.19) 42.53,42.25 42.21,42.25 ; v2(37.59,49.91) 37.59,49.65 37.84,49.4 39.01,49.4 ; v2(40.99,40.56) 40.99,40.56 40.61,40.95 ; 40.18,43.31 40.18,43.26 40.31,43.26 40.61,43.55 ; v2(41,48.39) 40.71,48.1 40.61,48.1 ; v2(34.86,47.56) 34.86,47.95 35.01,48.1 ; v2(33.73,49.07) 33.41,49.4
  内层4 w0.076: v2(37.18,42.16) 37.97,42.29 38.23,42.16 38.23,41.88 38.14,40.95
  内层4 w0.102: v2(37.16,40.87) 37.23,40.95 38.96,40.95 v2(39.37,40.54)
  内层4 w0.254: v3(10.06,54.18) 9.88,54.36 9.88,58.24 11.15,59.51 13.74,59.51 14.45,58.8 16.61,58.8 19.68,55.73 45.39,55.73 52.58,48.54 54.46,48.54 54.85,48.14 v2(58.43,48.14)
  Bottom Layer w0.203: 40.89,47.9 40.89,48.28 v2(41,48.39) ; v2(41.48,54.53) 41.42,54.48 41.42,54.31 ; v2(34.86,47.56) 34.67,47.75 34.67,47.98 ; v2(38.12,49.91) v2(37.59,49.91)
  Bottom Layer w0.254: v2(42.59,42.19) 42.59,42.34 42.95,42.7 43.2,42.7 ; v2(37.18,42.16) 37.08,42.06 36.6,42.06 ; 34.75,53.7 v2(35.41,53.7) ; v2(37.16,40.87) 37.08,40.95 36.43,40.95 ; v2(34.63,41.26) 34.61,41.25 34.39,41.25 33.79,40.66 ; 40.01,39.27 40.01,39.7 v2(39.87,39.85) ; v2(38.43,54.58) 38.73,54.28 39.02,54.28 ; v2(32.26,48.92) 32.54,49.2 33.6,49.2 v2(33.73,49.07) ; v2(43.2,52.4) 43.17,52.36 43.17,51.87 ; v2(35.48,46.63) 35.94,46.63 36.07,46.76 ; 39.8,41.91 v2(39.39,41.91) ; R38.2 59.41,44.62 v2(59.43,44.64) ; 39.27,39.95 39.27,40.44 v2(39.37,40.54) ; 35.59,50.99 34.62,50.99 v2(34.57,50.94) ; v2(37.59,49.91) 37.72,49.78 37.72,49.34 37.58,49.34 v2(37.05,49.87) ; v2(44.19,43.74) 43.83,44.1 43.83,44.22 ; v2(34.67,43.87) C117.1 ; v2(37.16,43.74) 37.49,44.07 37.49,44.28 v2(37.07,44.7) ; v2(37.11,52.37) 37.06,52.43 v2(37.06,53.26)
  Bottom Layer w0.305: v2(58.43,48.14) v2(58.43,47.64) 58.43,47.65 57.96,47.65 ; v2(59.93,44.64) 59.94,44.63 59.94,44.22 ; v2(59.93,44.64) v2(59.43,44.64) v2(58.93,44.64) ; v2(59.93,44.64) v2(60.43,44.64) ; v2(58.43,46.64) 58.42,46.63 57.96,46.63 57.96,45.53 57.98,45.52 ; v2(58.93,44.64) v2(58.43,44.64) ; v2(58.93,44.64) 58.93,44.25 C119.2 ; v2(58.43,44.64) 58.43,44.26 C155.2 ; v2(58.43,44.64) 57.98,45.1 57.98,45.52 ; 57.98,45.52 58.31,45.52 v2(58.43,45.64) ; v2(60.43,45.14) 60.43,45.13 v2(60.43,44.64) ; v2(60.43,44.64) v2(60.43,44.14) ; 58.43,47.14 57.96,47.14